# EasyEDA Pro project 3SE_24_Power_Rune.eprj, board 深大PCB参考
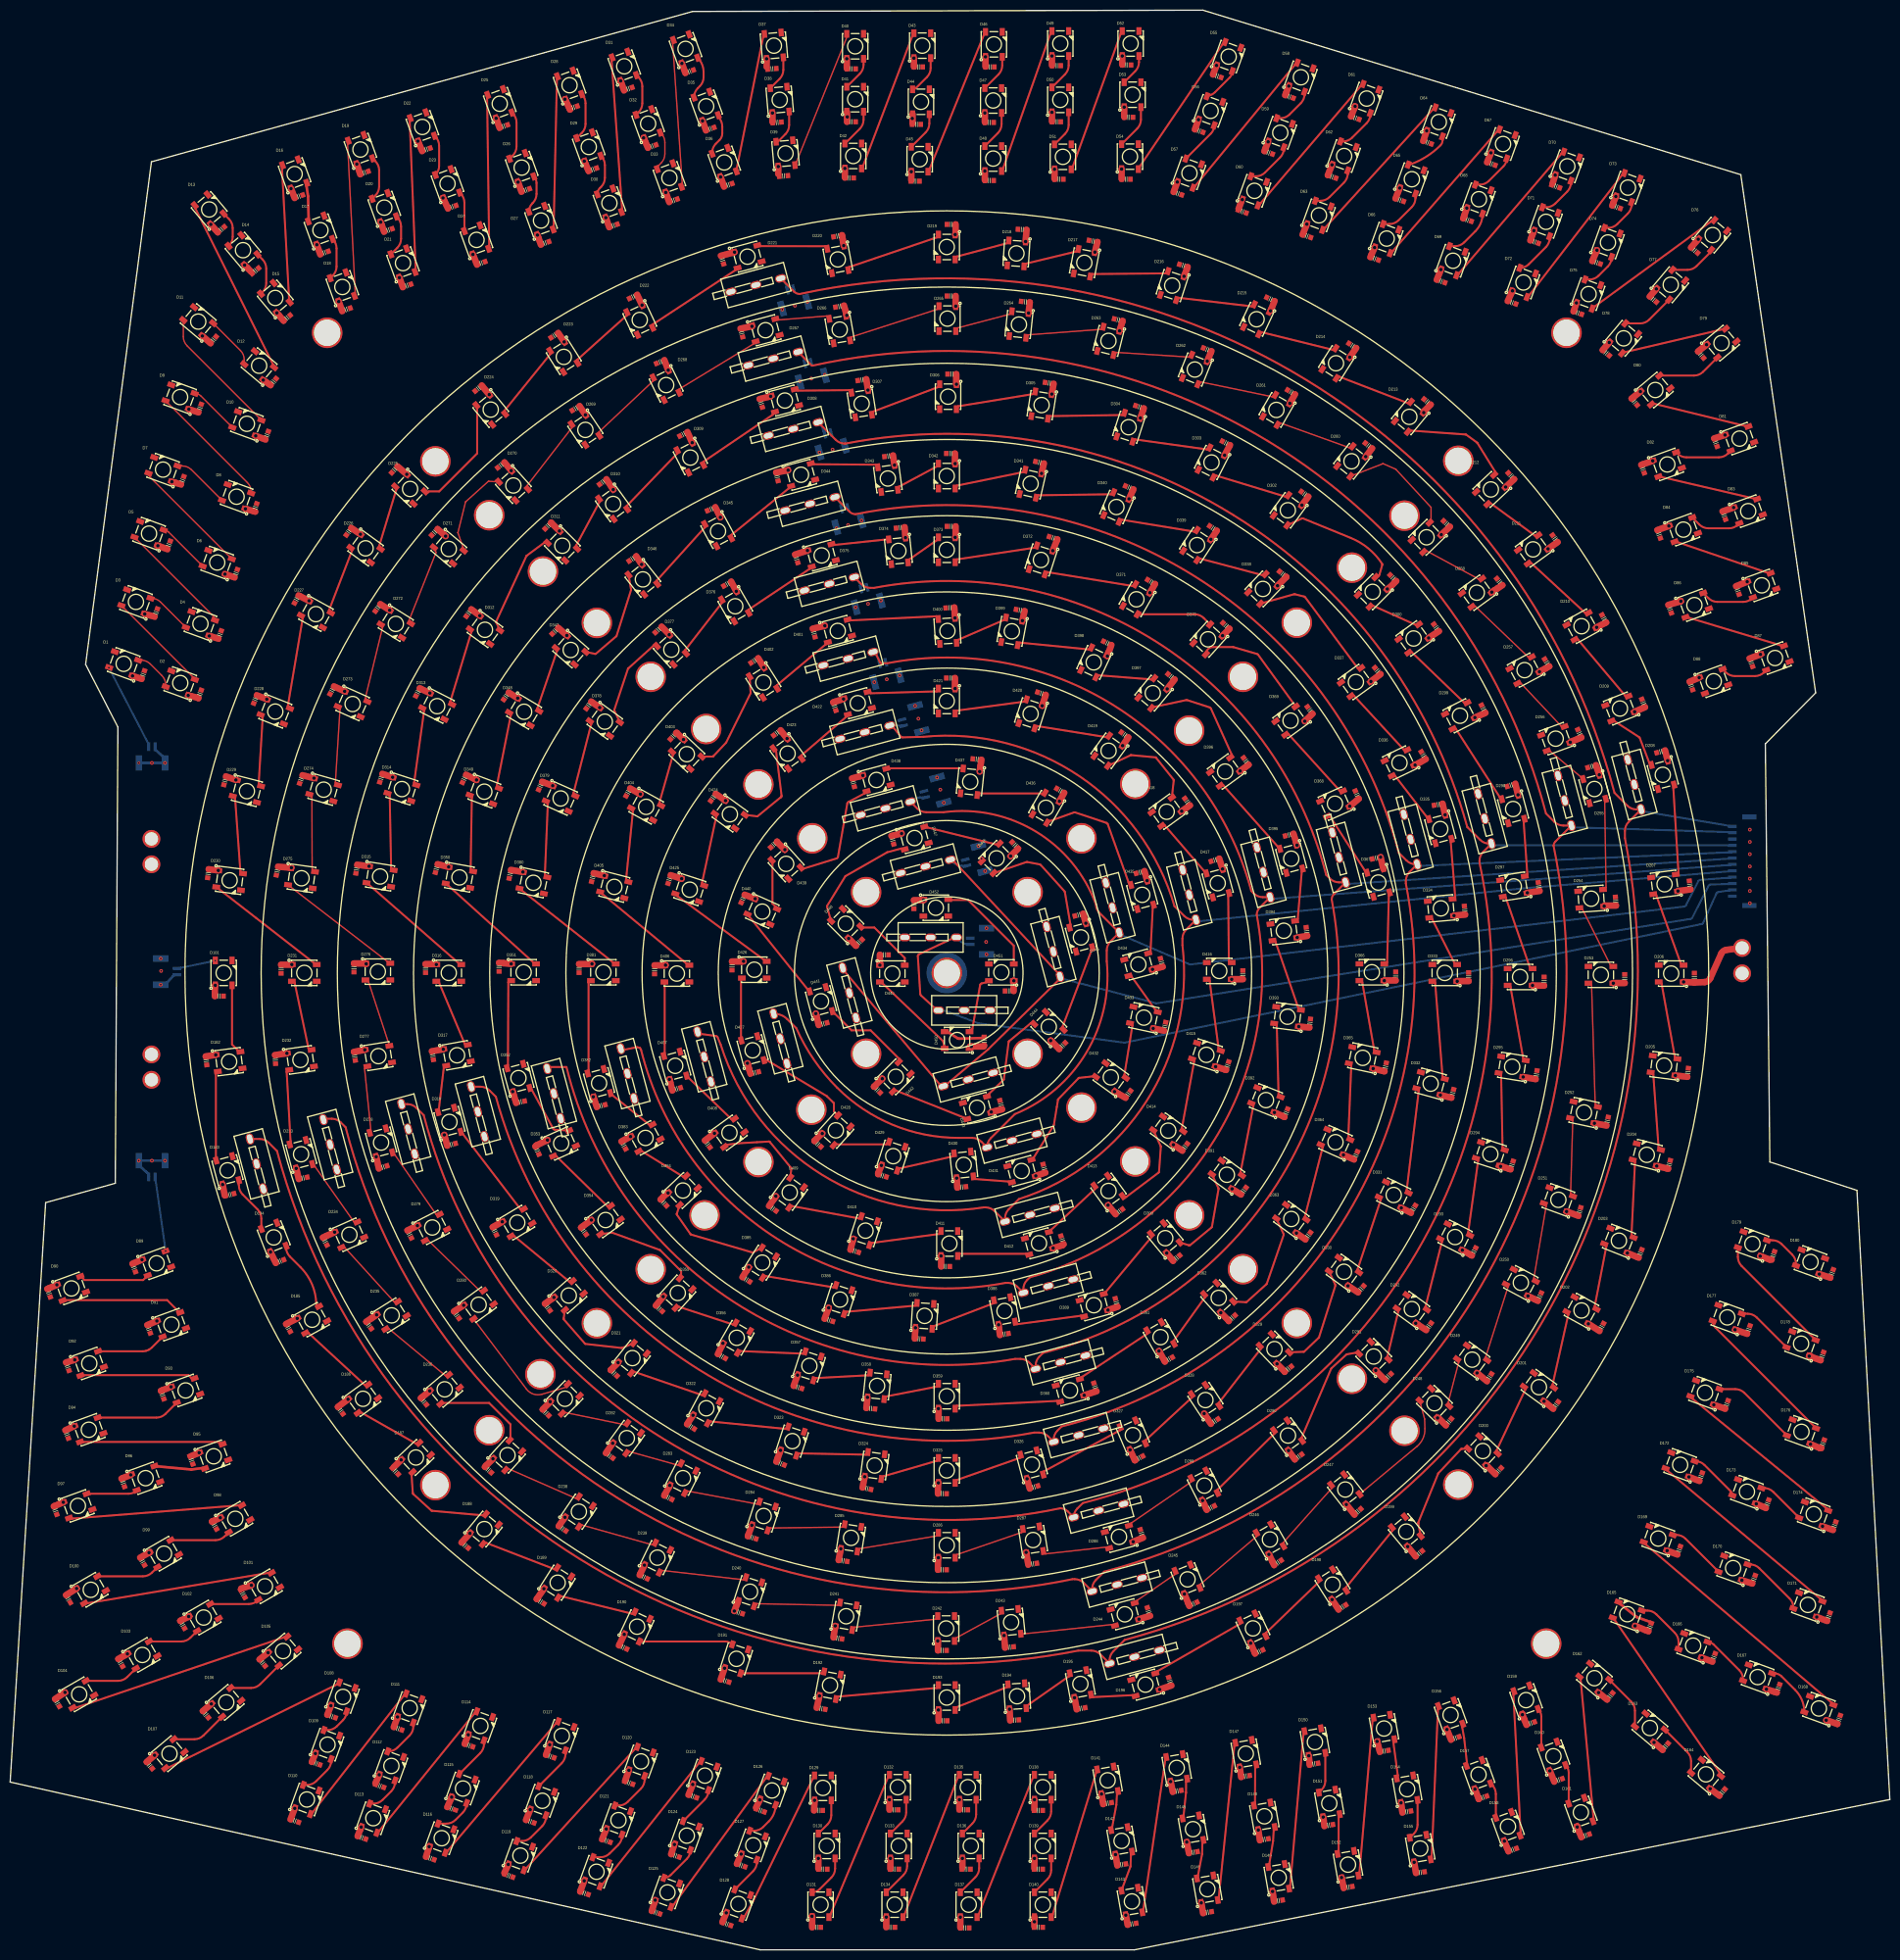
[diagram p15: board, top side]
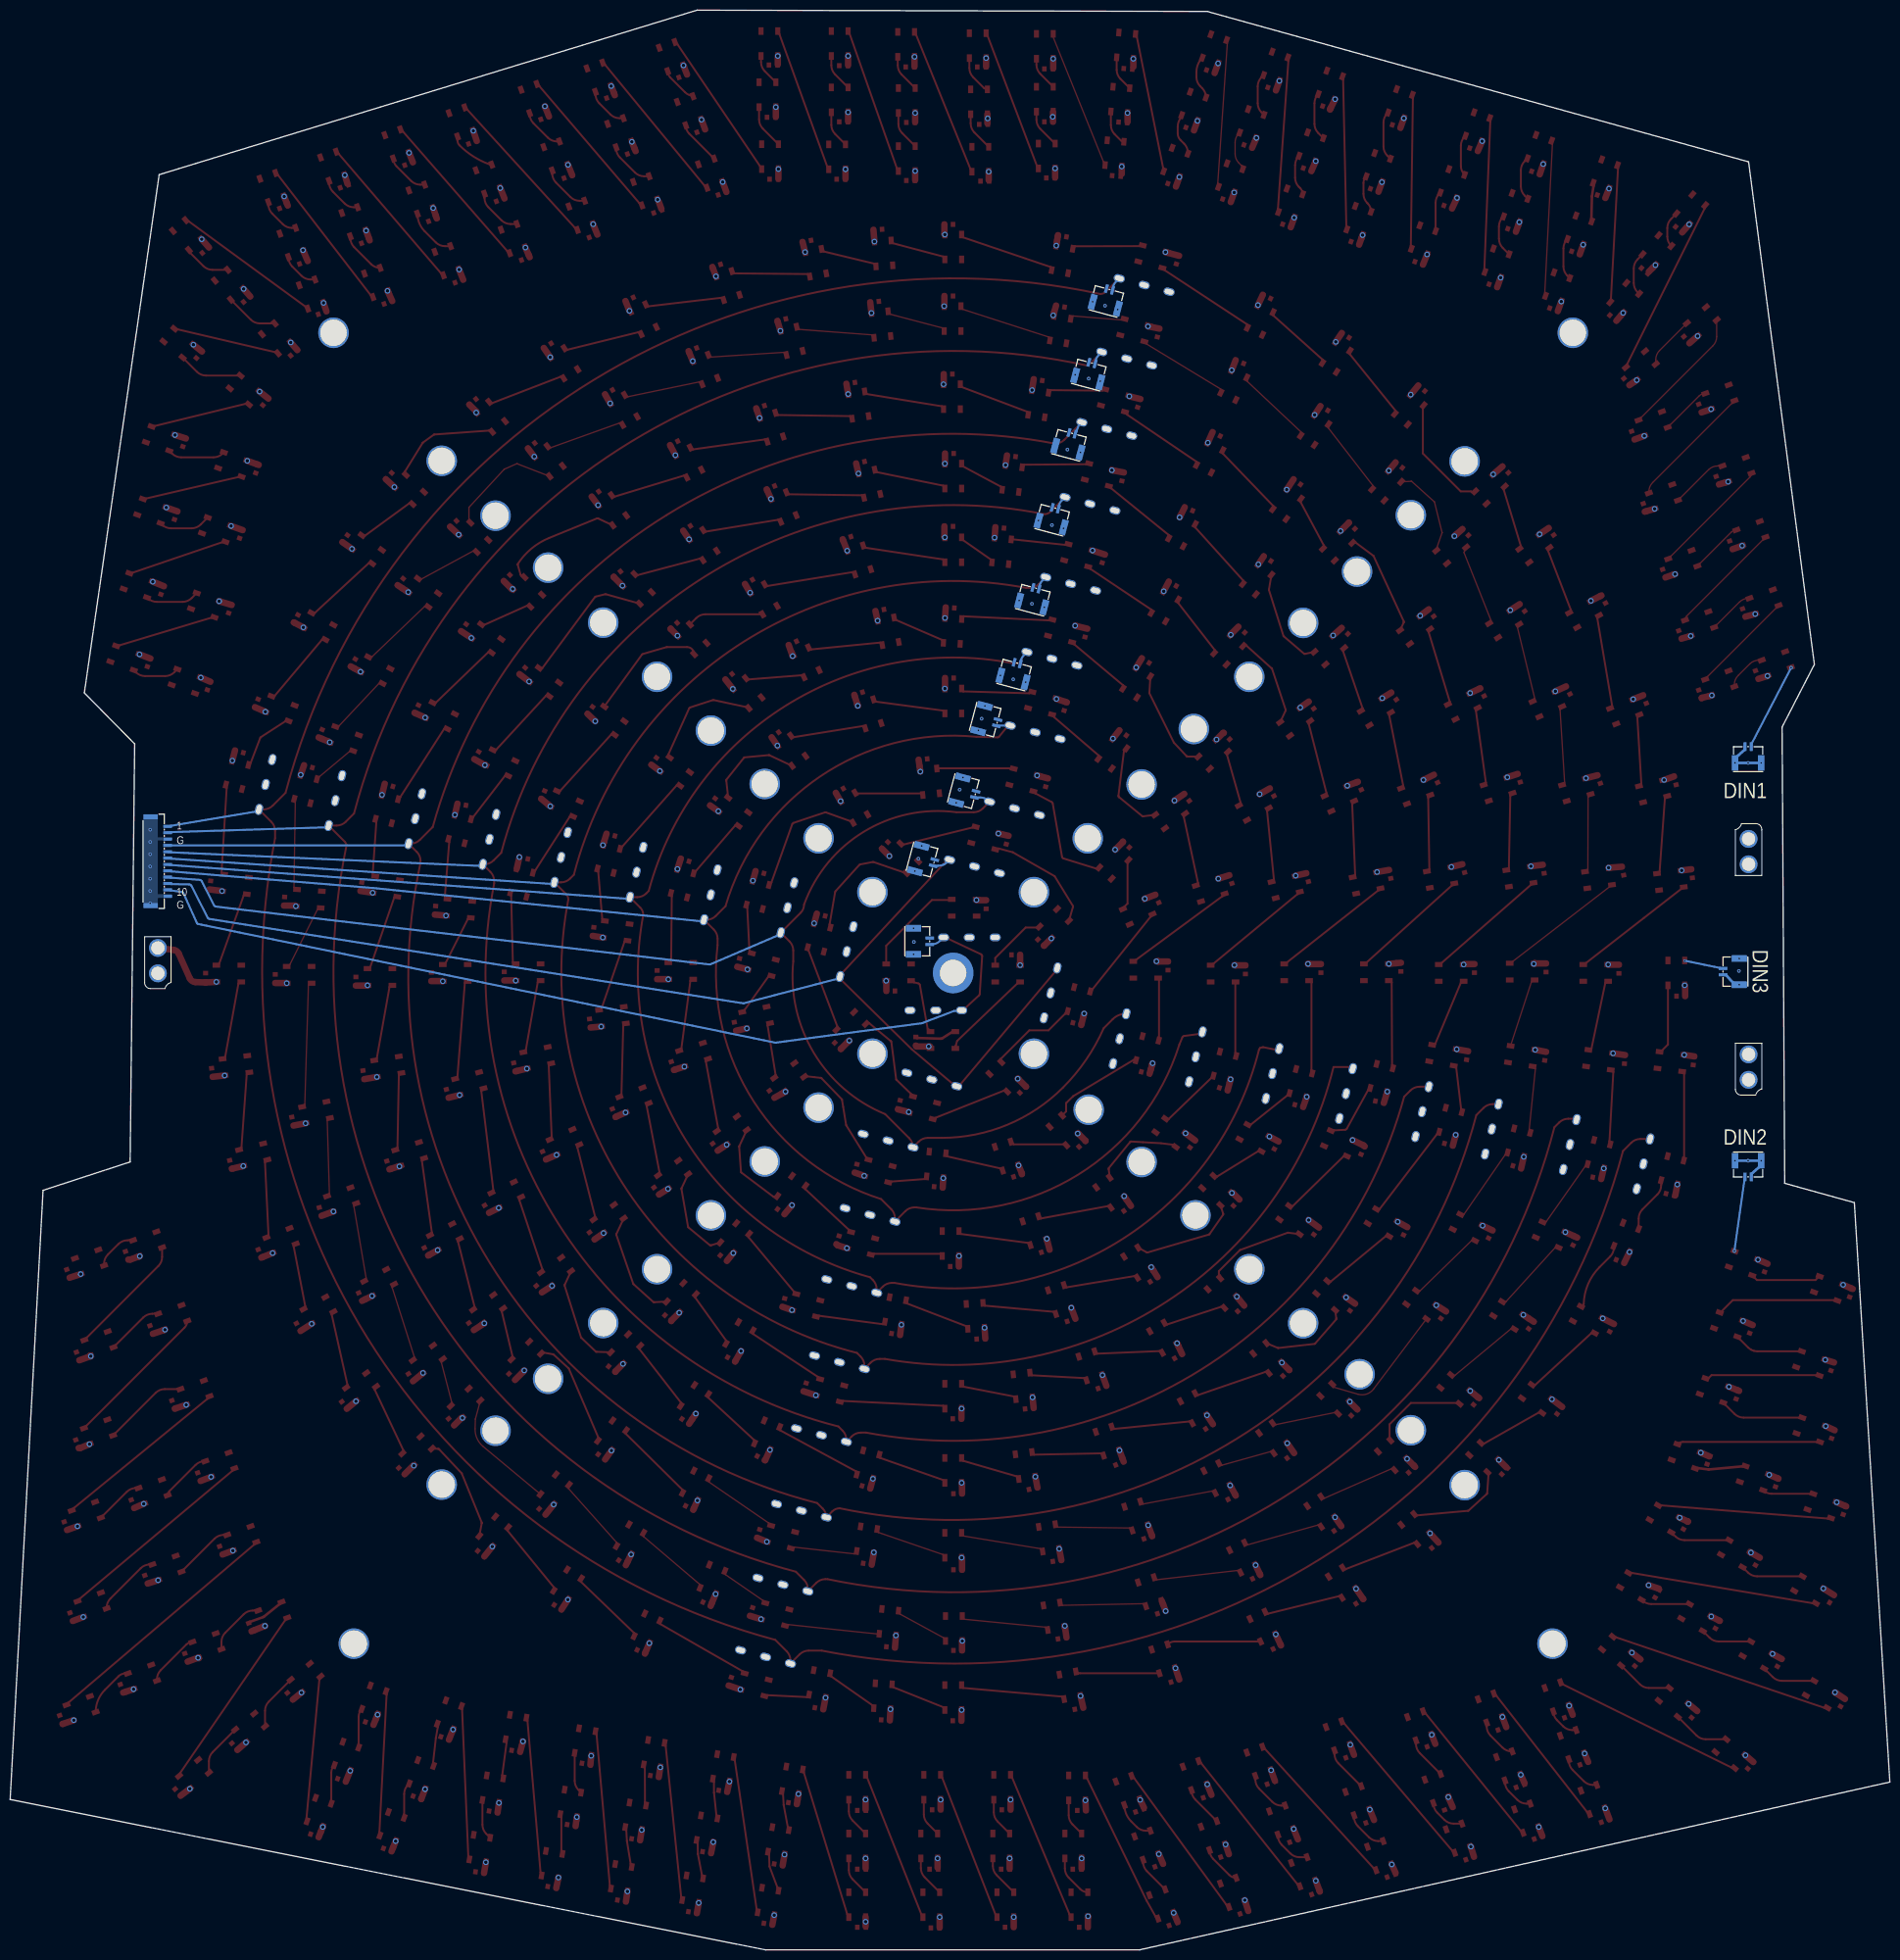
[diagram p16: board, bottom side, seen from below]

Outline 370.08 x 381.76 mm; copper layers: Top Layer, Bottom Layer. Coordinates in mm from the lower left corner of the outline.
Outline path: 0,33.02 6.98,147.07 20.7,150.88 21.21,240.67 14.86,252.98 27.81,351.92 134.37,381.51 234.82,381.76 340.74,349.38 355.47,247.4 345.57,237.36 346.46,155.07 363.6,149.48 370.08,29.59 221.34,0 147.68,0 0,33.02
Stack: Top Layer 0.0356mm / Dielectric 1 0.32mm FR-4 er 4.8 / Bottom Layer 0.0356mm

## Design rules (mm)
spacing Clearance (default): track to track 0.203, other pairs 0.203 to 0.203
track width Width_POWER (default): min 0.508, default 1.27, max 1.524
track width Width_OTHER: min 0.254, default 0.305, max 0.508
differential pair DiffPairsRouting (default): width min 0.381, default 0.381, max 0.381; gap min 0.254, default 0.254
via RoutingVias (default): diameter min 0.254, default 1.27, max 1.778; hole min 0.127, default 0.711, max 2.54

## Placement (name value [footprint] x y rotation side)
  -  [SW-TH_MICROSWITCH]  151.64 179.32 285 top
C1  -  [C_0603]  342.77 253.37 290 top
C2  -  [C_0603]  330.96 248.79 290 top
C3  -  [C_0603]  340.11 267.59 290 top
C4  -  [C_0603]  326.77 263.91 290 top
C5  -  [C_0603]  337.44 282.32 290 top
C6  -  [C_0603]  324.61 278.64 290 top
C7  -  [C_0603]  335.79 296.67 290 top
C8  -  [C_0603]  321.44 291.47 290 top
C9  -  [C_0603]  268.61 332.87 340 top
C10  -  [C_0603]  331.6 334.52 320 top
C11  -  [C_0603]  312.29 332.11 340 top
C12  -  [C_0603]  308.61 322.2 340 top
C13  -  [C_0603]  314.2 314.33 320 top
C14  -  [C_0603]  323.47 324.87 320 top
C15  -  [C_0603]  319.79 304.67 310 top
C16  -  [C_0603]  332.87 313.94 310 top
C17  -  [C_0603]  242.57 342.14 340 top
C18  -  [C_0603]  229.87 345.69 340 top
C19  -  [C_0603]  234.06 358.01 340 top
C20  -  [C_0603]  237.62 368.81 340 top
C21  -  [C_0603]  247.74 353.73 340 top
C22  -  [C_0603]  260.22 349 340 top
C23  -  [C_0603]  251.84 364.74 340 top
C24  -  [C_0603]  264.8 360.55 340 top
C25  -  [C_0603]  273.56 344.42 340 top
C26  -  [C_0603]  279.02 355.73 340 top
C27  -  [C_0603]  281.69 328.42 340 top
C28  -  [C_0603]  286.89 340.49 340 top
C29  -  [C_0603]  291.59 351.54 340 top
C30  -  [C_0603]  172.97 294 187.7 top
C31  -  [C_0603]  237.11 104.01 33.4 top
C32  -  [C_0603]  304.29 347.09 340 top
C33  -  [C_0603]  295.66 324.23 340 top
C34  -  [C_0603]  300.1 336.17 340 top
C35  -  [C_0603]  316.23 343.03 340 top
C36  -  [C_0603]  37.34 247.14 70 top
C37  -  [C_0603]  26.16 250.95 70 top
C38  -  [C_0603]  28.7 263.14 70 top
C39  -  [C_0603]  41.27 258.83 70 top
C40  -  [C_0603]  44.45 270.89 70 top
C41  -  [C_0603]  48.26 283.85 70 top
C42  -  [C_0603]  33.91 289.18 70 top
C43  -  [C_0603]  31.24 276.48 70 top
C44  -  [C_0603]  40.01 316.87 50 top
C45  -  [C_0603]  51.82 308.61 50 top
C46  -  [C_0603]  54.48 321.18 40 top
C47  -  [C_0603]  48.26 330.45 40 top
C48  -  [C_0603]  41.53 338.58 40 top
C49  -  [C_0603]  37.34 303.4 70 top
C50  -  [C_0603]  130.56 344.3 20 top
C51  -  [C_0603]  110.87 362.59 20 top
C52  -  [C_0603]  121.67 366.27 20 top
C53  -  [C_0603]  126.36 354.97 20 top
C54  -  [C_0603]  178.18 348.11 0 top
C55  -  [C_0603]  219.84 370.97 0 top
C56  -  [C_0603]  152.27 349.12 5 top
C57  -  [C_0603]  165.23 348.74 0 top
C58  -  [C_0603]  206.5 348.49 0 top
C59  -  [C_0603]  151 359.66 5 top
C60  -  [C_0603]  255.27 337.31 340 top
C61  -  [C_0603]  192.79 348.23 0 top
C62  -  [C_0603]  165.61 359.79 0 top
C63  -  [C_0603]  178.82 370.59 0 top
C64  -  [C_0603]  165.61 370.21 0 top
C65  -  [C_0603]  205.99 370.84 0 top
C66  -  [C_0603]  192.91 370.59 0 top
C67  -  [C_0603]  192.79 359.66 0 top
C68  -  [C_0603]  178.44 359.28 0 top
C69  -  [C_0603]  149.99 370.21 5 top
C70  -  [C_0603]  205.99 359.79 0 top
C71  -  [C_0603]  92.71 331.98 20 top
C72  -  [C_0603]  118.75 339.34 20 top
C73  -  [C_0603]  97.16 358.9 20 top
C74  -  [C_0603]  220.22 360.68 0 top
C75  -  [C_0603]  114.68 350.39 20 top
C76  -  [C_0603]  87 343.03 20 top
C77  -  [C_0603]  137.8 358.39 20 top
C78  -  [C_0603]  101.47 346.33 20 top
C79  -  [C_0603]  105.28 335.92 20 top
C80  -  [C_0603]  219.71 348.49 0 top
C81  -  [C_0603]  78.1 327.53 20 top
C82  -  [C_0603]  69.72 349.76 20 top
C83  -  [C_0603]  81.91 354.33 20 top
C84  -  [C_0603]  74.42 338.46 20 top
C85  -  [C_0603]  56.81 345.1 20 top
C86  -  [C_0603]  61.85 334.01 20 top
C87  -  [C_0603]  133.73 369.7 20 top
C88  -  [C_0603]  66.17 322.83 20 top
C89  -  [C_0603]  26.03 76.45 300 top
C90  -  [C_0603]  117.35 21.46 340 top
C91  -  [C_0603]  7.62 129.29 290 top
C92  -  [C_0603]  24.38 134.24 290 top
C93  -  [C_0603]  314.96 49.91 50 top
C94  -  [C_0603]  45.8 70.08 300 top
C95  -  [C_0603]  113.03 11.18 340 top
C96  -  [C_0603]  11.18 101.47 290 top
C97  -  [C_0603]  141.1 5.08 340 top
C98  -  [C_0603]  35.69 96.39 290 top
C99  -  [C_0603]  11.3 114.81 290 top
C100  -  [C_0603]  158.75 4.44 0 top
C101  -  [C_0603]  27.3 122.17 290 top
C102  -  [C_0603]  246.89 21.72 10 top
C103  -  [C_0603]  243.2 34.16 10 top
C104  -  [C_0603]  335.41 57.53 70 top
C105  -  [C_0603]  322.83 63.5 70 top
C106  -  [C_0603]  360.04 45.34 70 top
C107  -  [C_0603]  249.68 9.65 10 top
C108  -  [C_0603]  348.11 51.44 70 top
C109  -  [C_0603]  76.33 43.56 340 top
C110  -  [C_0603]  9.27 48.64 300 top
C111  -  [C_0603]  22.22 91.95 290 top
C112  -  [C_0603]  63.25 45.97 340 top
C113  -  [C_0603]  69.22 22.1 340 top
C114  -  [C_0603]  72.77 32.26 340 top
C115  -  [C_0603]  40.21 83.54 300 top
C116  -  [C_0603]  8.89 86.49 290 top
C117  -  [C_0603]  21.72 56.52 300 top
C118  -  [C_0603]  33.91 64.01 300 top
C119  -  [C_0603]  11.43 69.09 300 top
C120  -  [C_0603]  202.44 27.43 0 top
C121  -  [C_0603]  220.85 5.08 10 top
C122  -  [C_0603]  218.82 16.76 10 top
C123  -  [C_0603]  60.2 36.7 340 top
C124  -  [C_0603]  173.36 4.44 0 top
C125  -  [C_0603]  202.44 4.44 0 top
C126  -  [C_0603]  216.03 28.83 10 top
C127  -  [C_0603]  310.13 22.48 20 top
C128  -  [C_0603]  337.06 30.99 50 top
C129  -  [C_0603]  325.88 40.01 50 top
C130  -  [C_0603]  256.67 36.58 10 top
C131  -  [C_0603]  299.34 44.58 20 top
C132  -  [C_0603]  304.8 33.4 20 top
C133  -  [C_0603]  121.79 32.89 340 top
C134  -  [C_0603]  147.7 27.43 340 top
C135  -  [C_0603]  143.89 16.64 340 top
C136  -  [C_0603]  130.94 18.54 340 top
C137  -  [C_0603]  134.37 30.23 340 top
C138  -  [C_0603]  29.97 109.22 290 top
C139  -  [C_0603]  332.87 93.09 70 top
C140  -  [C_0603]  359.16 83.44 70 top
C141  -  [C_0603]  358.01 65.53 70 top
C142  -  [C_0603]  328.55 78.61 70 top
C143  -  [C_0603]  343.28 72.9 70 top
C144  -  [C_0603]  232.92 19.18 10 top
C145  -  [C_0603]  82.68 18.03 340 top
C146  -  [C_0603]  263.4 12.32 10 top
C147  -  [C_0603]  289.94 29.97 20 top
C148  -  [C_0603]  259.59 24.51 10 top
C149  -  [C_0603]  86.87 27.81 340 top
C150  -  [C_0603]  106.3 38.1 340 top
C151  -  [C_0603]  127.13 7.37 340 top
C152  -  [C_0603]  102.36 25.27 340 top
C153  -  [C_0603]  90.3 40.26 340 top
C154  -  [C_0603]  98.17 14.61 340 top
C155  -  [C_0603]  187.96 4.32 0 top
C156  -  [C_0603]  27.43 36.32 310 top
C157  -  [C_0603]  38.48 46.36 310 top
C158  -  [C_0603]  49.66 56.52 310 top
C159  -  [C_0603]  56.01 25.4 340 top
C160  -  [C_0603]  173.99 27.56 0 top
C161  -  [C_0603]  188.21 15.88 0 top
C162  -  [C_0603]  202.44 15.88 0 top
C163  -  [C_0603]  187.71 27.56 0 top
C164  -  [C_0603]  174.12 15.88 0 top
C165  -  [C_0603]  159.13 27.43 0 top
C166  -  [C_0603]  160.02 15.88 0 top
C167  -  [C_0603]  270.51 39.12 10 top
C168  -  [C_0603]  274.95 27.18 10 top
C169  -  [C_0603]  141.35 347.35 20 top
C170  -  [C_0603]  50.55 298.07 70 top
C171  -  [C_0603]  342.26 122.05 70 top
C172  -  [C_0603]  356.74 116.84 70 top
C173  -  [C_0603]  356.87 99.57 70 top
C174  -  [C_0603]  337.95 107.32 70 top
C175  -  [C_0603]  358.65 133.1 70 top
C176  -  [C_0603]  229.74 31.24 10 top
C177  -  [C_0603]  235.71 7.37 10 top
C178  -  [C_0603]  295.78 19.69 20 top
C179  -  [C_0603]  284.48 41.66 20 top
C180  -  [C_0603]  347.09 136.65 70 top
C181  -  [C_0603]  331.6 191.39 90 top
C182  -  [C_0603]  330.31 172.67 82.8 top
C183  -  [C_0603]  326.64 154.56 75.6 top
C184  -  [C_0603]  320.93 137.03 68.4 top
C185  -  [C_0603]  313.31 122.56 61.2 top
C186  -  [C_0603]  304.29 107.19 54 top
C187  -  [C_0603]  292.99 94.23 46.8 top
C188  -  [C_0603]  277.37 77.98 39.6 top
C189  -  [C_0603]  262.25 67.44 32.4 top
C190  -  [C_0603]  245.87 58.67 25.2 top
C191  -  [C_0603]  228.35 52.83 108 top
C192  -  [C_0603]  210.82 47.5 10.8 top
C193  -  [C_0603]  197.74 45.21 3.6 top
C194  -  [C_0603]  183.64 45.09 0 top
C195  -  [C_0603]  159.64 47.5 349.2 top
C196  -  [C_0603]  140.72 52.96 342 top
C197  -  [C_0603]  120.65 59.56 334.8 top
C198  -  [C_0603]  104.39 68.58 327.6 top
C199  -  [C_0603]  89.53 79.63 320.4 top
C200  -  [C_0603]  75.82 94.23 313.2 top
C201  -  [C_0603]  65.02 106.17 306 top
C202  -  [C_0603]  54.74 122.43 298.8 top
C203  -  [C_0603]  53.09 135.51 21.6 top
C204  -  [C_0603]  43.25 148.63 14.4 top
C205  -  [C_0603]  38.61 175.01 277.2 top
C206  -  [C_0603]  41.15 187.71 0 top
C207  -  [C_0603]  38.99 211.84 262.8 top
C208  -  [C_0603]  42.29 230.12 255.6 top
C209  -  [C_0603]  48.26 246.13 248.4 top
C210  -  [C_0603]  56.39 265.81 241.2 top
C211  -  [C_0603]  66.67 279.15 234 top
C212  -  [C_0603]  75.69 291.34 226.8 top
C213  -  [C_0603]  92.2 307.34 219.6 top
C214  -  [C_0603]  107.19 317.75 212.4 top
C215  -  [C_0603]  122.68 325.37 205.2 top
C216  -  [C_0603]  140.21 332.61 288 top
C217  -  [C_0603]  162.94 337.31 190.8 top
C218  -  [C_0603]  185.29 339.6 180 top
C219  -  [C_0603]  199.26 338.58 176.4 top
C220  -  [C_0603]  213.23 336.3 169.2 top
C221  -  [C_0603]  231.01 331.47 162 top
C222  -  [C_0603]  248.16 324.87 154.8 top
C223  -  [C_0603]  264.29 315.72 147.6 top
C224  -  [C_0603]  279.02 304.67 140.4 top
C225  -  [C_0603]  295.53 290.07 133.2 top
C226  -  [C_0603]  304.16 277.75 126 top
C227  -  [C_0603]  313.82 262 118.8 top
C228  -  [C_0603]  321.56 245.36 111.6 top
C229  -  [C_0603]  324.99 235.84 195 top
C230  -  [C_0603]  330.71 209.55 97.2 top
C231  -  [C_0603]  317.88 191.14 90 top
C232  -  [C_0603]  314.45 163.07 78 top
C233  -  [C_0603]  308.99 145.29 74 top
C234  -  [C_0603]  301.12 128.52 66 top
C235  -  [C_0603]  291.21 112.65 58 top
C236  -  [C_0603]  283.21 103.89 50 top
C237  -  [C_0603]  265.3 86.23 42 top
C238  -  [C_0603]  249.56 76.2 34 top
C239  -  [C_0603]  232.92 68.07 26 top
C240  -  [C_0603]  224.15 66.55 108 top
C241  -  [C_0603]  196.72 59.56 6 top
C242  -  [C_0603]  183.51 58.93 0 top
C243  -  [C_0603]  162.94 61.34 350 top
C244  -  [C_0603]  143.38 66.42 342 top
C245  -  [C_0603]  124.71 73.41 334 top
C246  -  [C_0603]  108.71 82.93 326 top
C247  -  [C_0603]  94.11 94.49 318 top
C248  -  [C_0603]  81.41 107.95 310 top
C249  -  [C_0603]  70.61 122.94 306 top
C250  -  [C_0603]  61.98 139.45 298 top
C251  -  [C_0603]  163.32 323.47 190 top
C252  -  [C_0603]  57.66 151.89 12 top
C253  -  [C_0603]  52.2 175.26 274 top
C254  -  [C_0603]  53.34 193.04 270 top
C255  -  [C_0603]  52.58 212.34 258 top
C256  -  [C_0603]  57.28 230.38 250 top
C257  -  [C_0603]  63.37 247.9 242 top
C258  -  [C_0603]  72.39 264.16 234 top
C259  -  [C_0603]  83.57 279.02 226 top
C260  -  [C_0603]  96.65 292.23 218 top
C261  -  [C_0603]  111.38 303.4 210 top
C262  -  [C_0603]  128.02 312.55 202 top
C263  -  [C_0603]  144.02 318.26 284 top
C264  -  [C_0603]  185.29 325.5 180 top
C265  -  [C_0603]  199.9 324.36 174 top
C266  -  [C_0603]  218.19 320.8 166 top
C267  -  [C_0603]  235.71 314.96 158 top
C268  -  [C_0603]  252.22 306.58 150 top
C269  -  [C_0603]  267.46 296.04 142 top
C270  -  [C_0603]  282.83 280.67 138 top
C271  -  [C_0603]  293.24 269.24 130 top
C272  -  [C_0603]  302.57 253.32 122 top
C273  -  [C_0603]  308.99 239.4 114 top
C274  -  [C_0603]  311.4 232.92 196 top
C275  -  [C_0603]  316.1 206.38 94 top
C276  -  [C_0603]  302.01 190.63 90 top
C277  -  [C_0603]  300.48 172.21 81 top
C278  -  [C_0603]  295.66 154.43 72 top
C279  -  [C_0603]  288.16 137.41 63 top
C280  -  [C_0603]  279.27 122.68 54 top
C281  -  [C_0603]  271.27 112.78 45 top
C282  -  [C_0603]  253.62 97.03 36 top
C283  -  [C_0603]  236.35 87 27 top
C284  -  [C_0603]  222.76 81.92 108 top
C285  -  [C_0603]  201.3 75.95 9 top
C286  -  [C_0603]  183.51 74.8 0 top
C287  -  [C_0603]  163.96 76.58 351 top
C288  -  [C_0603]  146.05 81.15 342 top
C289  -  [C_0603]  129.54 89.03 333 top
C290  -  [C_0603]  117.98 97.28 324 top
C291  -  [C_0603]  105.44 105.76 315 top
C292  -  [C_0603]  87.88 124.97 306 top
C293  -  [C_0603]  78.61 140.84 297 top
C294  -  [C_0603]  73.41 154.05 18 top
C295  -  [C_0603]  67.82 175.9 279 top
C296  -  [C_0603]  67.69 193.29 270 top
C297  -  [C_0603]  68.2 212.73 261 top
C298  -  [C_0603]  73.03 230.63 252 top
C299  -  [C_0603]  80.26 247.53 243 top
C300  -  [C_0603]  90.3 263.14 234 top
C301  -  [C_0603]  105.92 280.29 225 top
C302  -  [C_0603]  116.71 288.93 216 top
C303  -  [C_0603]  132.59 298.32 207 top
C304  -  [C_0603]  147.83 304.42 288 top
C305  -  [C_0603]  167.72 309 189 top
C306  -  [C_0603]  185.42 310.13 180 top
C307  -  [C_0603]  204.6 308.36 171 top
C308  -  [C_0603]  222.38 303.66 162 top
C309  -  [C_0603]  239.39 296.55 153 top
C310  -  [C_0603]  254.89 286.51 144 top
C311  -  [C_0603]  272.29 270 135 top
C312  -  [C_0603]  280.8 260.22 126 top
C313  -  [C_0603]  290.07 244.22 117 top
C314  -  [C_0603]  295.53 229.24 198 top
C315  -  [C_0603]  300.98 209.25 99 top
C316  -  [C_0603]  286.38 204.6 95 top
C317  -  [C_0603]  287.15 191.52 90 top
C318  -  [C_0603]  283.97 168.53 74.6 top
C319  -  [C_0603]  276.23 145.8 59.1 top
C320  -  [C_0603]  265.94 130.05 48.9 top
C321  -  [C_0603]  251.59 114.3 38.6 top
C322  -  [C_0603]  222.25 96.77 28.3 top
C323  -  [C_0603]  201.55 91.06 18 top
C324  -  [C_0603]  277.62 15.24 7.7 top
C325  -  [C_0603]  183.51 89.79 359 top
C326  -  [C_0603]  168.66 90.81 347.1 top
C327  -  [C_0603]  151.64 95.76 336.9 top
C328  -  [C_0603]  133.99 103 326.6 top
C329  -  [C_0603]  118.87 113.54 316.3 top
C330  -  [C_0603]  105.79 126.49 306 top
C331  -  [C_0603]  95.38 141.48 295.7 top
C332  -  [C_0603]  83.19 176.02 280 top
C333  -  [C_0603]  81.79 193.17 270 top
C334  -  [C_0603]  86.87 158.5 15 top
C335  -  [C_0603]  83.95 212.85 254.6 top
C336  -  [C_0603]  89.41 230.51 244.3 top
C337  -  [C_0603]  97.66 246.76 234 top
C338  -  [C_0603#2]  107.31 259.59 223.7 top
C339  -  [C_0603]  122.55 273.81 213.4 top
C340  -  [C_0603]  138.05 283.59 203.2 top
C341  -  [C_0603]  151 289.94 282.9 top
C342  -  [C_0603]  185.17 294.51 180 top
C343  -  [C_0603]  202.69 292.74 167.1 top
C344  -  [C_0603]  220.35 287.78 156.9 top
C345  -  [C_0603]  236.86 279.78 146.6 top
C346  -  [C_0603]  250.57 270.76 141.4 top
C347  -  [C_0603]  269.24 251.71 131.2 top
C348  -  [C_0603]  278.26 235.08 120.9 top
C349  -  [C_0603]  195.71 121.16 10 top
C350  -  [C_0603]  281.18 225.43 190.3 top
C351  -  [C_0603]  272.8 191.64 90 top
C352  -  [C_0603]  270.76 173.74 78 top
C353  -  [C_0603]  264.92 156.34 66 top
C354  -  [C_0603]  255.52 140.51 54 top
C355  -  [C_0603]  240.54 124.33 42 top
C356  -  [C_0603]  228.09 116.21 30 top
C357  -  [C_0603]  213.61 110.74 108 top
C358  -  [C_0603]  183.64 104.52 0 top
C359  -  [C_0603]  169.42 106.55 354 top
C360  -  [C_0603]  155.07 110.74 342 top
C361  -  [C_0603]  140.08 116.84 330 top
C362  -  [C_0603]  127.76 126.24 318 top
C363  -  [C_0603]  112.9 141.48 306 top
C364  -  [C_0603]  103.76 157.35 294 top
C365  -  [C_0603]  100.46 166.88 12 top
C366  -  [C_0603]  96.27 193.42 270 top
C367  -  [C_0603]  98.42 211.71 258 top
C368  -  [C_0603]  104.39 229.11 246 top
C369  -  [C_0603]  113.92 244.98 234 top
C370  -  [C_0603]  127.64 259.84 222 top
C371  -  [C_0603]  141.22 268.86 210 top
C372  -  [C_0603]  154.81 273.81 288 top
C373  -  [C_0603]  175.26 279.91 186 top
C374  -  [C_0603]  185.29 280.16 180 top
C375  -  [C_0603]  205.36 277.88 162 top
C376  -  [C_0603]  224.66 269.24 150 top
C377  -  [C_0603]  239.39 260.6 138 top
C378  -  [C_0603]  255.9 243.97 126 top
C379  -  [C_0603]  265.18 227.33 114 top
C380  -  [C_0603]  268.99 214.88 192 top
C381  -  [C_0603]  255.27 200.41 97.2 top
C382  -  [C_0603]  255.9 182.37 82.8 top
C383  -  [C_0603]  251.21 164.72 68.4 top
C384  -  [C_0603]  242.82 149.35 54 top
C385  -  [C_0603]  229.62 136.14 39.6 top
C386  -  [C_0603]  217.81 127.38 105 top
C387  -  [C_0603]  178.94 120.27 356.4 top
C388  -  [C_0603]  161.16 123.95 342 top
C389  -  [C_0603]  144.91 131.95 327.6 top
C390  -  [C_0603]  128.65 147.07 313.2 top
C391  -  [C_0603]  120.78 158.37 298.8 top
C392  -  [C_0603]  116.33 166.12 15 top
C393  -  [C_0603]  345.95 87.76 70 top
C394  -  [C_0603]  112.01 193.17 270 top
C395  -  [C_0603]  114.68 211.07 255.6 top
C396  -  [C_0603]  121.67 227.84 241.2 top
C397  -  [C_0603]  130.56 238.89 226.8 top
C398  -  [C_0603]  146.56 253.75 212.4 top
C399  -  [C_0603]  158.24 259.21 285 top
C400  -  [C_0603]  185.04 264.16 183.6 top
C401  -  [C_0603]  198.88 263.65 169.2 top
C402  -  [C_0603]  216.03 257.18 154.8 top
C403  -  [C_0603]  228.6 250.57 140.4 top
C404  -  [C_0603]  243.33 233.93 126 top
C405  -  [C_0603]  251.84 219.46 194.4 top
C406  -  [C_0603]  242.7 191.9 90 top
C407  -  [C_0603]  239.65 173.99 72 top
C408  -  [C_0603]  231.27 157.99 54 top
C409  -  [C_0603]  218.31 145.29 36 top
C410  -  [C_0603]  207.14 139.7 108 top
C411  -  [C_0603]  184.15 134.49 0 top
C412  -  [C_0603]  166.24 137.54 342 top
C413  -  [C_0603]  150.11 145.92 324 top
C414  -  [C_0603]  137.29 158.62 306 top
C415  -  [C_0603]  131.19 169.42 18 top
C416  -  [C_0603]  126.87 192.91 270 top
C417  -  [C_0603]  129.79 210.69 252 top
C418  -  [C_0603]  138.43 226.82 234 top
C419  -  [C_0603]  151 239.52 216 top
C420  -  [C_0603]  162.31 244.73 288 top
C421  -  [C_0603]  185.17 250.32 180 top
C422  -  [C_0603]  203.07 247.27 162 top
C423  -  [C_0603]  219.46 239.14 144 top
C424  -  [C_0603]  231.77 225.93 126 top
C425  -  [C_0603]  237.24 214.5 198 top
C426  -  [C_0603]  226.69 194.31 105 top
C427  -  [C_0603]  227.33 181.74 78 top